# EasyEDA Pro project Access Control V2.1.eprj, schematic V2.1.1 Core Schematic

## Sheets
1 Microcontroller: Create Date: 2024-05-16; Page Name: Microcontroller.V2.1.V2.1.1 Core Schematic; Project Name: Access Control V2.1; Schematic Name: V2.1.1 Core Schematic; Update Date: 2024-05-22; Company: RIT SHED MAKERSPACE; Drawn: Jim Heaney; Page Size: A4; Part Number: N/A; Reviewed: Jim Heaney; Version: V2.1.0
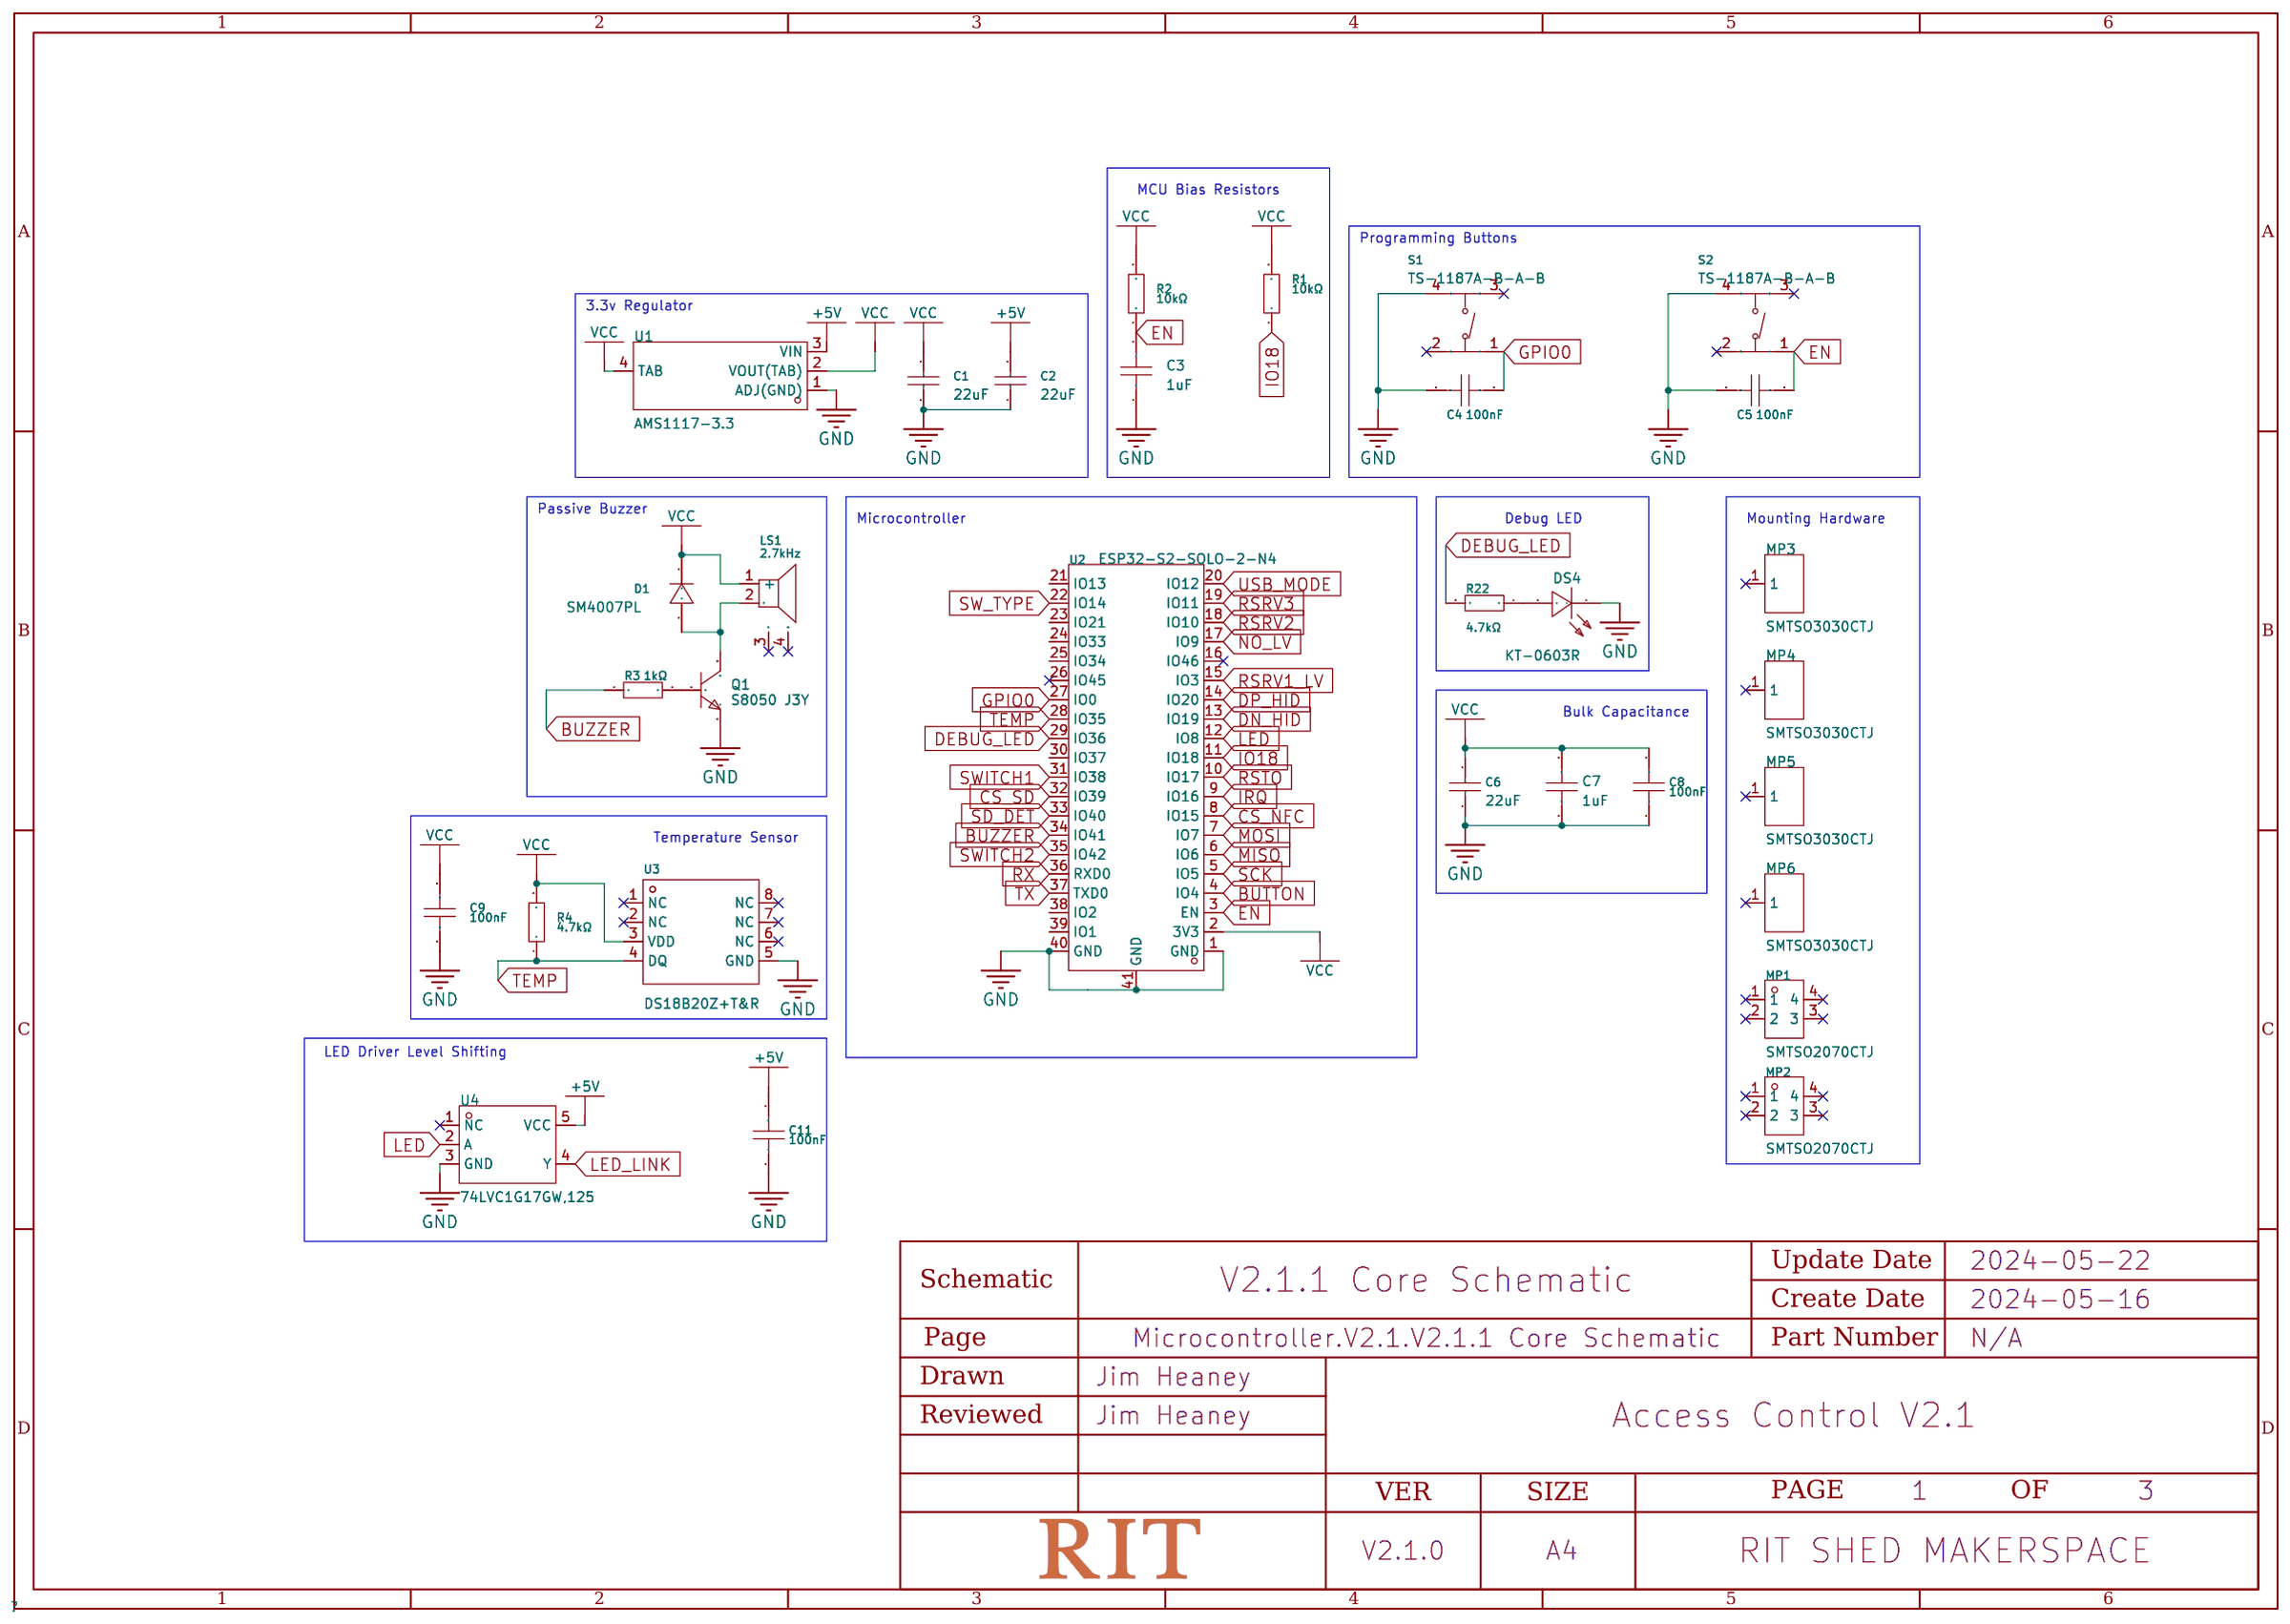
[diagram p3: Microcontroller]
2 Interface: Page Name: Interface; Schematic Name: V2.1.0 Core Schematic; Update Date: 2024-05-20
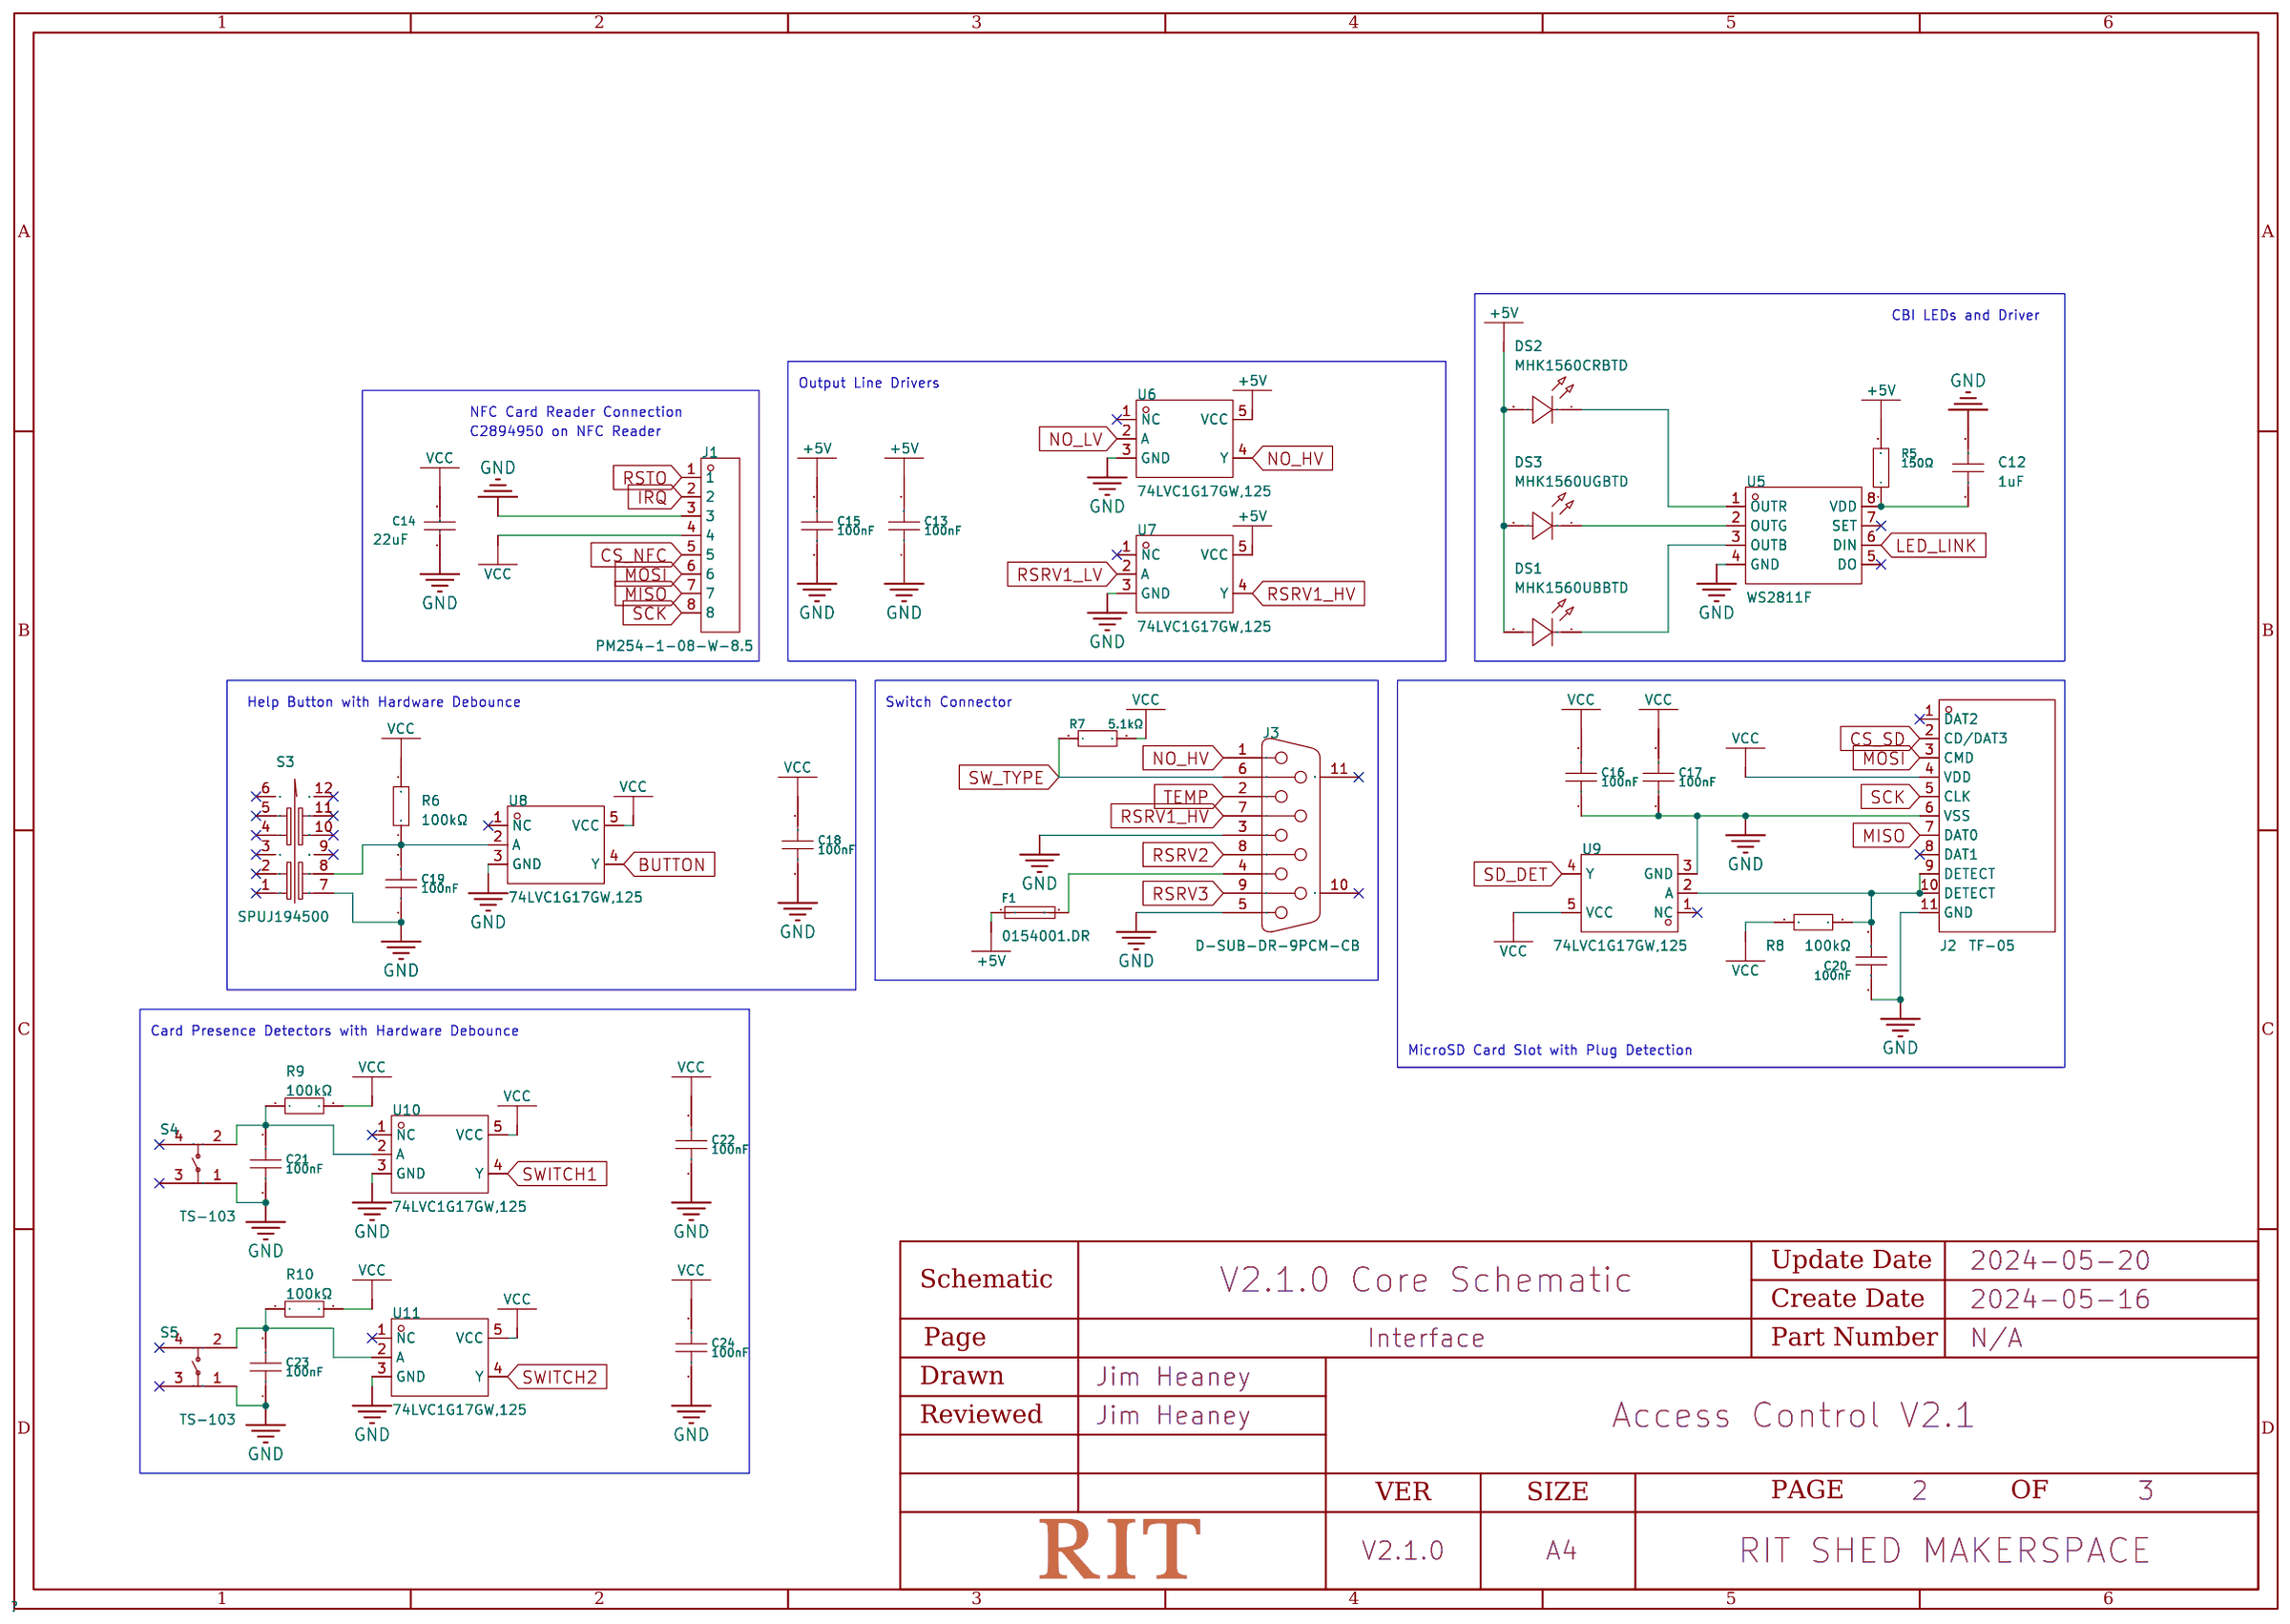
[diagram p4: Interface]
3 USB: Create Date: 2024-05-17; Page Name: USB; Schematic Name: V2.1.0 Core Schematic; Update Date: 2024-05-21
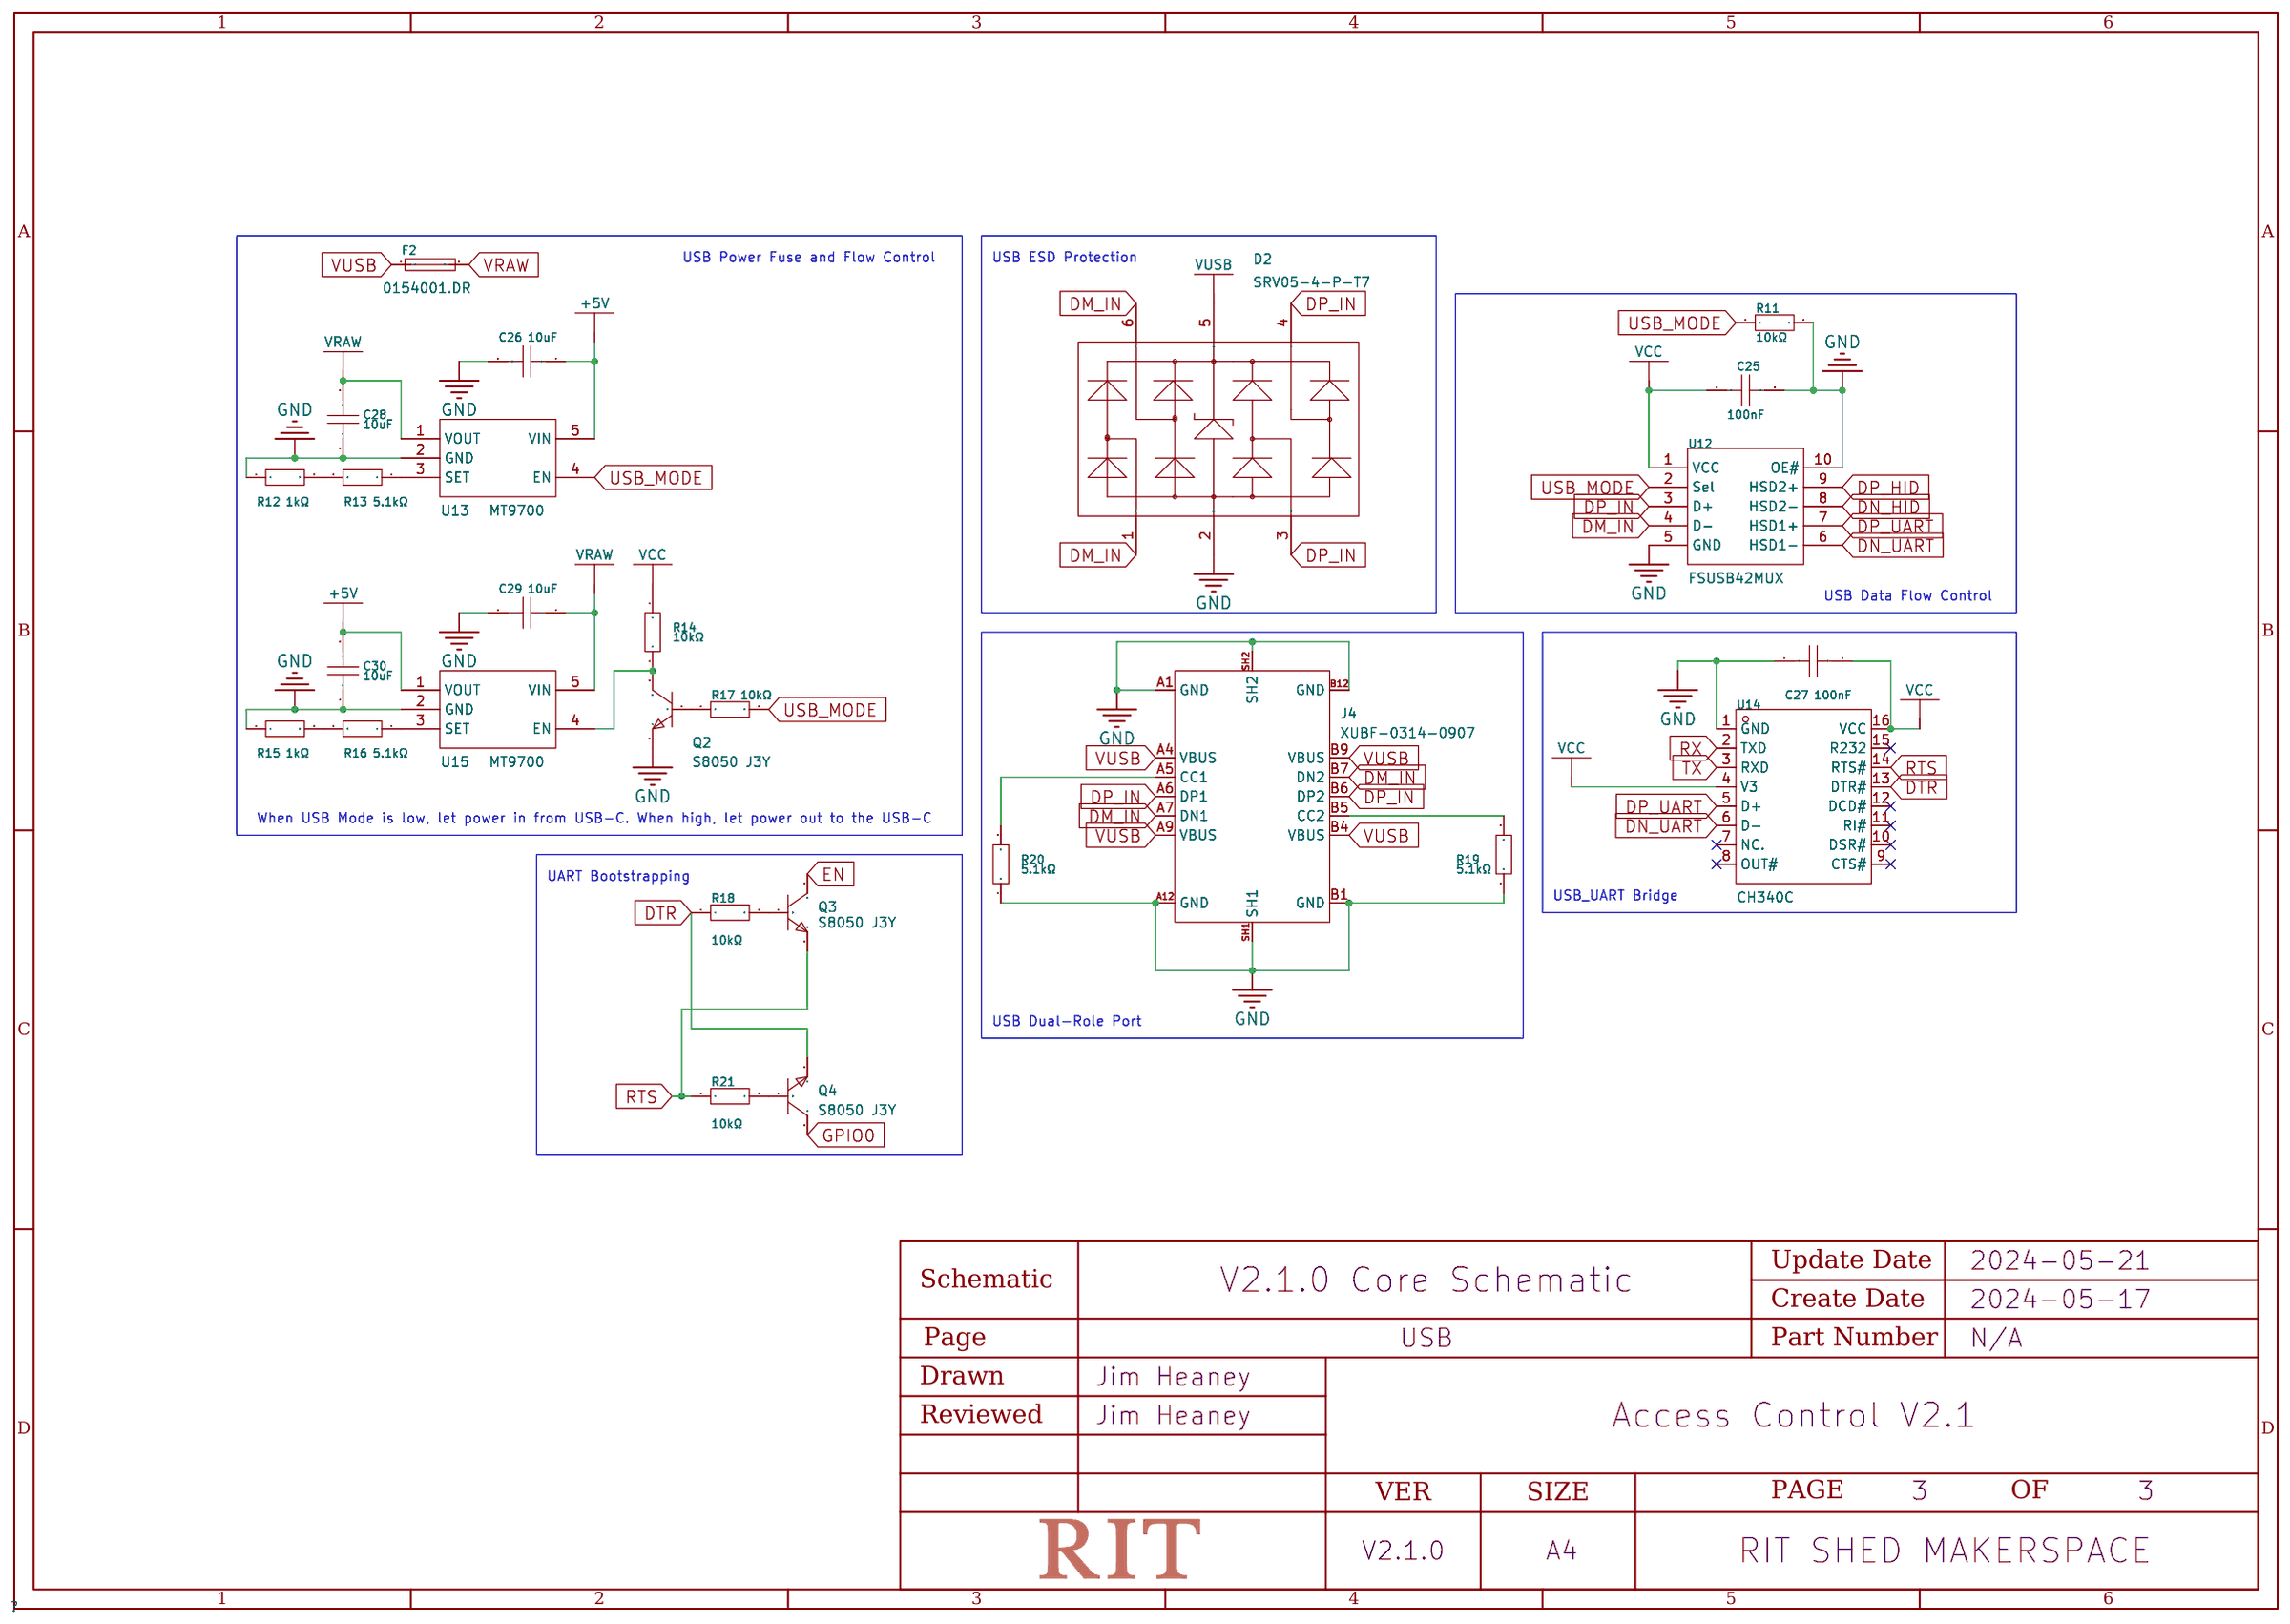
[diagram p5: USB]
